# Altium schematic sheet FPGA_SUP.SchDoc
size 420 x 297 mm
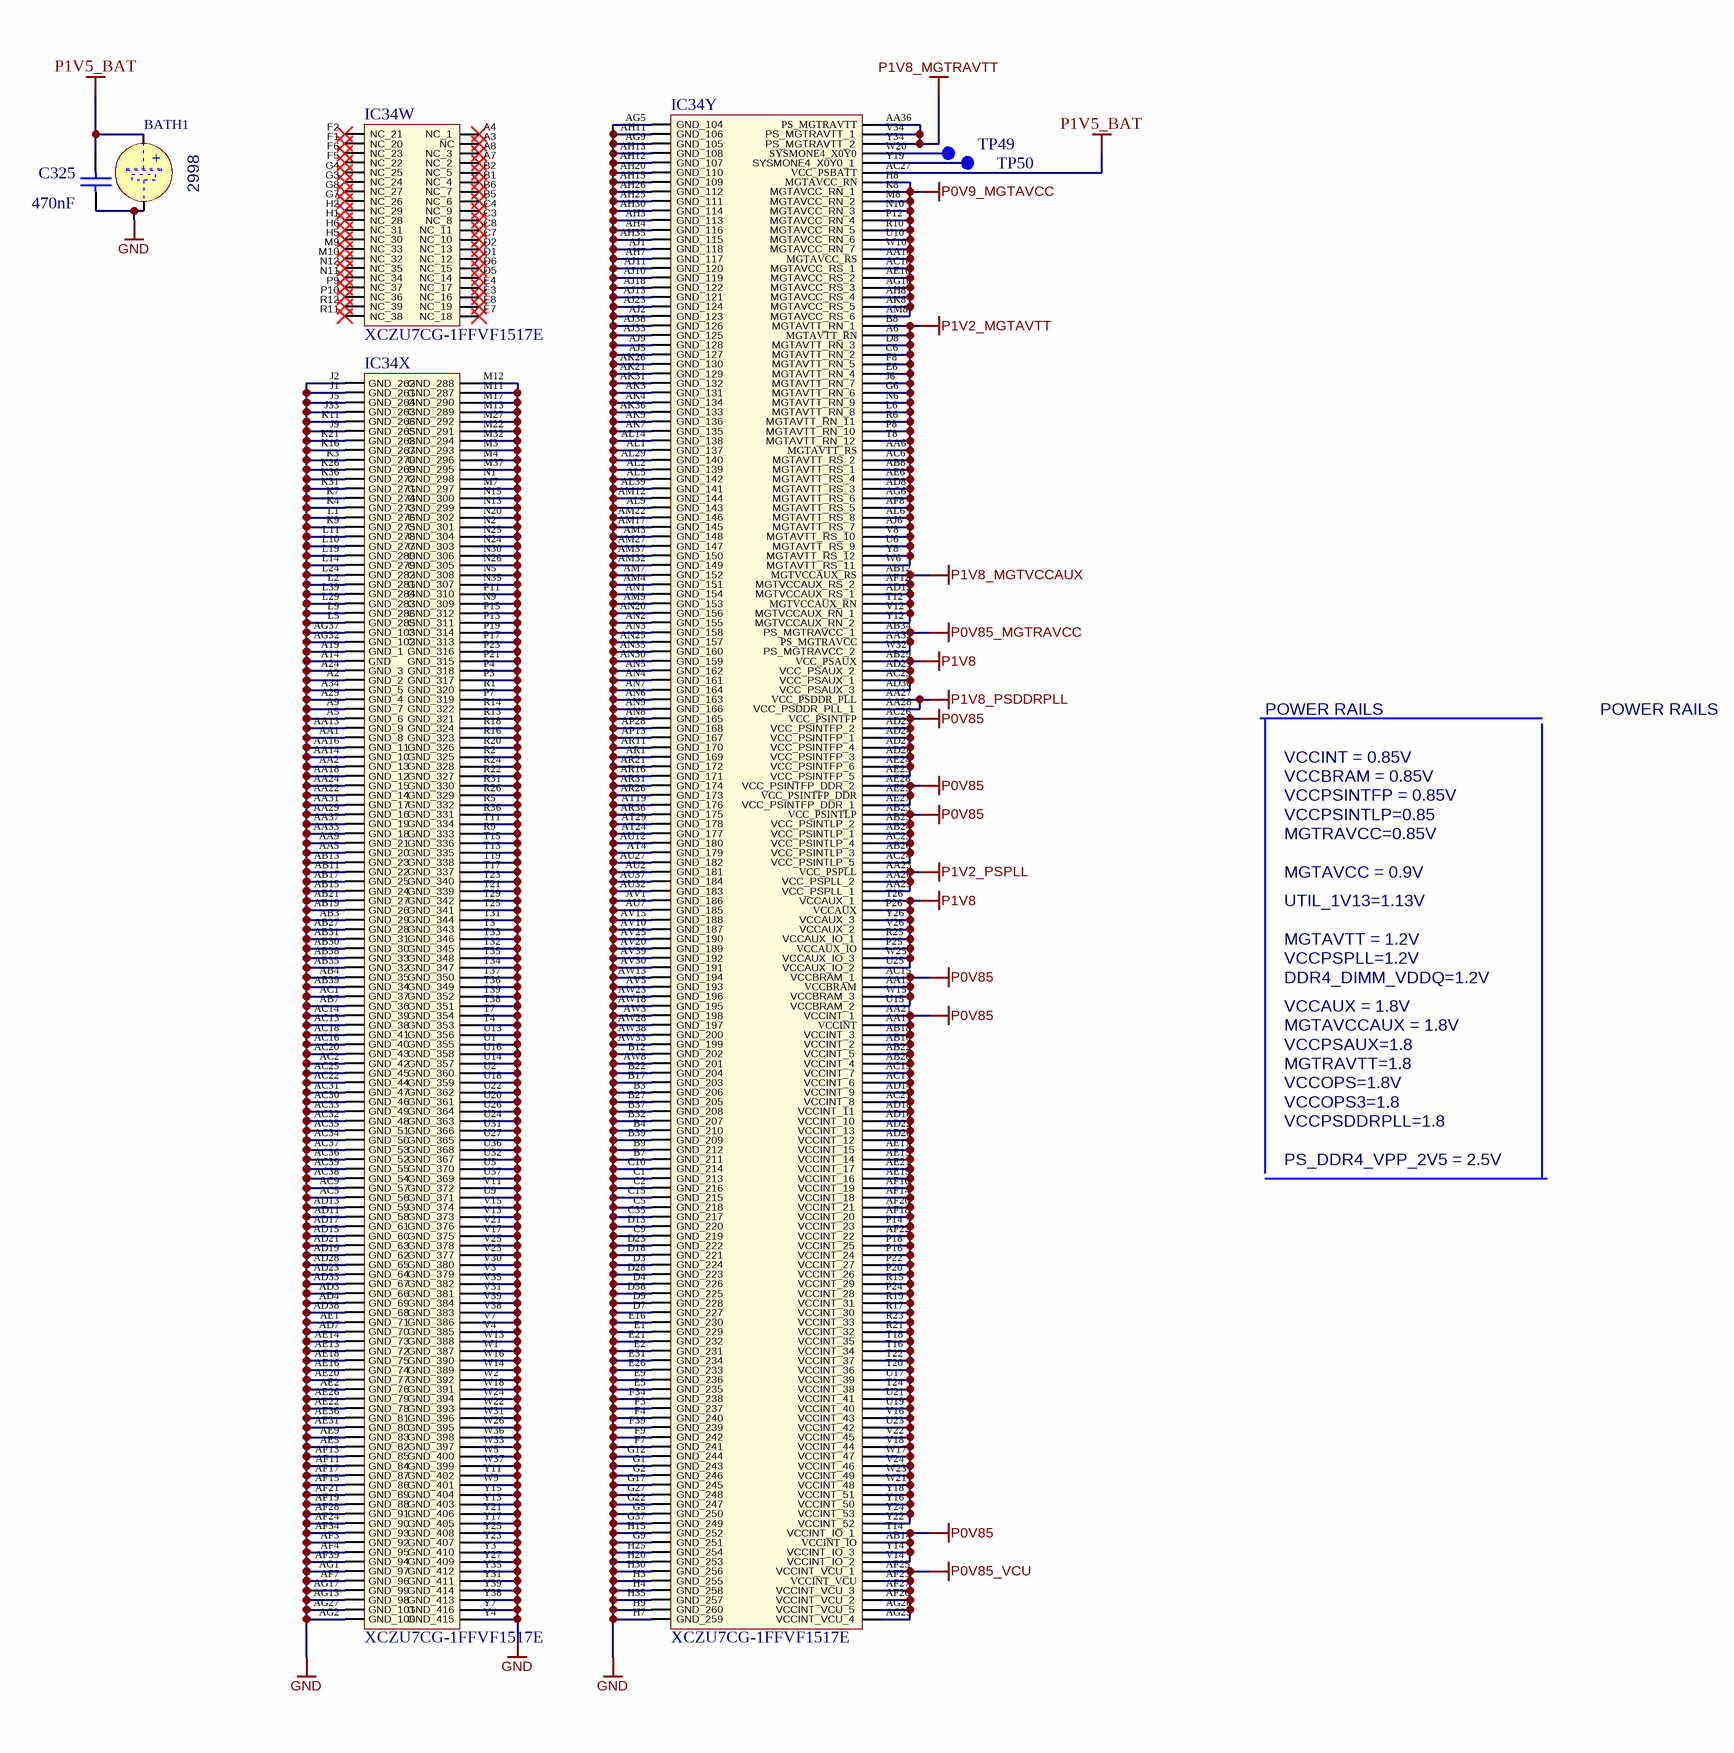
[diagram p0: FPGA_SUP.SchDoc]

## Parts
BATH1  Manufacturer Part Number: 2998  [BATH_KEYSTONE_2998]
C325  470nF  [CAPC0603X33N]
IC34  XCZU7CG-1FFVF1517E  (parts W,X,Y of 26)
TP49  SMD Pad  [C100]  (value not drawn)
TP50  SMD Pad  [C100]  (value not drawn)

## Nets
GND: BATH1.2(MINUS) C325.1 IC34.A2(GND_2) IC34.A5(GND_6) IC34.A9(GND_7) IC34.A14(GND) IC34.A19(GND_1) IC34.A24(GND_3) IC34.A29(GND_4) IC34.A34(GND_5) IC34.AA1(GND_8) IC34.AA2(GND_13) IC34.AA5(GND_20) IC34.AA9(GND_21) IC34.AA13(GND_9) IC34.AA14(GND_10) IC34.AA16(GND_11) IC34.AA18(GND_12) IC34.AA22(GND_14) IC34.AA24(GND_15) IC34.AA29(GND_16) IC34.AA31(GND_17) IC34.AA33(GND_18) IC34.AA37(GND_19) IC34.AB3(GND_29) IC34.AB4(GND_35) IC34.AB7(GND_36) IC34.AB11(GND_22) IC34.AB13(GND_23) IC34.AB15(GND_24) IC34.AB17(GND_25) IC34.AB19(GND_26) IC34.AB21(GND_27) IC34.AB27(GND_28) IC34.AB30(GND_30) IC34.AB31(GND_31) IC34.AB35(GND_32) IC34.AB38(GND_33) IC34.AB39(GND_34) IC34.AC1(GND_37) IC34.AC2(GND_42) IC34.AC5(GND_56) IC34.AC9(GND_57) IC34.AC13(GND_38) IC34.AC14(GND_39) IC34.AC16(GND_40) IC34.AC18(GND_41) IC34.AC20(GND_43) IC34.AC22(GND_44) IC34.AC25(GND_45) IC34.AC30(GND_46) IC34.AC31(GND_47) IC34.AC32(GND_48) IC34.AC33(GND_49) IC34.AC34(GND_50) IC34.AC35(GND_51) IC34.AC36(GND_52) IC34.AC37(GND_53) IC34.AC38(GND_54) IC34.AC39(GND_55) IC34.AD3(GND_66) IC34.AD4(GND_69) IC34.AD7(GND_70) IC34.AD11(GND_58) IC34.AD13(GND_59) IC34.AD15(GND_60) IC34.AD17(GND_61) IC34.AD19(GND_62) IC34.AD21(GND_63) IC34.AD23(GND_64) IC34.AD28(GND_65) IC34.AD33(GND_67) IC34.AD38(GND_68) IC34.AE1(GND_71) IC34.AE2(GND_76) IC34.AE5(GND_82) IC34.AE9(GND_83) IC34.AE13(GND_72) IC34.AE14(GND_73) IC34.AE16(GND_74) IC34.AE18(GND_75) IC34.AE20(GND_77) IC34.AE22(GND_78) IC34.AE26(GND_79) IC34.AE31(GND_80) IC34.AE36(GND_81) IC34.AF3(GND_92) IC34.AF4(GND_95) IC34.AF7(GND_96) IC34.AF11(GND_84) IC34.AF13(GND_85) IC34.AF15(GND_86) IC34.AF17(GND_87) IC34.AF19(GND_88) IC34.AF21(GND_89) IC34.AF24(GND_90) IC34.AF28(GND_91) IC34.AF34(GND_93) IC34.AF39(GND_94) IC34.AG1(GND_97) IC34.AG2(GND_100) IC34.AG5(GND_104) IC34.AG9(GND_105) IC34.AG13(GND_98) IC34.AG17(GND_99) IC34.AG27(GND_101) IC34.AG32(GND_102) IC34.AG37(GND_103) IC34.AH3(GND_113) IC34.AH4(GND_116) IC34.AH7(GND_117) IC34.AH11(GND_106) IC34.AH12(GND_107) IC34.AH13(GND_108) IC34.AH15(GND_109) IC34.AH20(GND_110) IC34.AH25(GND_111) IC34.AH26(GND_112) IC34.AH30(GND_114) IC34.AH35(GND_115) IC34.AJ1(GND_118) IC34.AJ2(GND_123) IC34.AJ5(GND_127) IC34.AJ9(GND_128) IC34.AJ10(GND_119) IC34.AJ11(GND_120) IC34.AJ13(GND_121) IC34.AJ18(GND_122) IC34.AJ23(GND_124) IC34.AJ33(GND_125) IC34.AJ38(GND_126) IC34.AK3(GND_131) IC34.AK4(GND_134) IC34.AK7(GND_135) IC34.AK9(GND_136) IC34.AK21(GND_129) IC34.AK26(GND_130) IC34.AK31(GND_132) IC34.AK36(GND_133) IC34.AL1(GND_137) IC34.AL2(GND_139) IC34.AL5(GND_142) IC34.AL9(GND_143) IC34.AL14(GND_138) IC34.AL29(GND_140) IC34.AL39(GND_141) IC34.AM3(GND_148) IC34.AM4(GND_151) IC34.AM7(GND_152) IC34.AM9(GND_153) IC34.AM12(GND_144) IC34.AM17(GND_145) IC34.AM22(GND_146) IC34.AM27(GND_147) IC34.AM32(GND_149) IC34.AM37(GND_150) IC34.AN1(GND_154) IC34.AN2(GND_155) IC34.AN3(GND_158) IC34.AN4(GND_161) IC34.AN5(GND_162) IC34.AN6(GND_163) IC34.AN7(GND_164) IC34.AN8(GND_165) IC34.AN9(GND_166) IC34.AN20(GND_156) IC34.AN25(GND_157) IC34.AN30(GND_159) IC34.AN35(GND_160) IC34.AP13(GND_167) IC34.AP28(GND_168) IC34.AR1(GND_169) IC34.AR11(GND_170) IC34.AR16(GND_171) IC34.AR21(GND_172) IC34.AR26(GND_173) IC34.AR31(GND_174) IC34.AR36(GND_175) IC34.AT4(GND_179) IC34.AT19(GND_176) IC34.AT24(GND_177) IC34.AT29(GND_178) IC34.AU2(GND_181) IC34.AU7(GND_185) IC34.AU12(GND_180) IC34.AU27(GND_182) IC34.AU32(GND_183) IC34.AU37(GND_184) IC34.AV1(GND_186) IC34.AV5(GND_193) IC34.AV10(GND_187) IC34.AV15(GND_188) IC34.AV20(GND_189) IC34.AV25(GND_190) IC34.AV30(GND_191) IC34.AV39(GND_192) IC34.AW3(GND_198) IC34.AW8(GND_201) IC34.AW13(GND_194) IC34.AW18(GND_195) IC34.AW23(GND_196) IC34.AW28(GND_197) IC34.AW33(GND_199) IC34.AW38(GND_200) IC34.B3(GND_206) IC34.B4(GND_210) IC34.B7(GND_211) IC34.B9(GND_212) IC34.B12(GND_202) IC34.B17(GND_203) IC34.B22(GND_204) IC34.B27(GND_205) IC34.B32(GND_207) IC34.B37(GND_208) IC34.B39(GND_209) IC34.C1(GND_213) IC34.C2(GND_216) IC34.C5(GND_218) IC34.C9(GND_219) IC34.C10(GND_214) IC34.C15(GND_215) IC34.C35(GND_217) IC34.D3(GND_224) IC34.D4(GND_226) IC34.D7(GND_227) IC34.D9(GND_228) IC34.D13(GND_220) IC34.D18(GND_221) IC34.D23(GND_222) IC34.D28(GND_223) IC34.D38(GND_225) IC34.E1(GND_229) IC34.E2(GND_231) IC34.E5(GND_235) IC34.E9(GND_236) IC34.E16(GND_230) IC34.E21(GND_232) IC34.E26(GND_233) IC34.E31(GND_234) IC34.F3(GND_237) IC34.F4(GND_240) IC34.F7(GND_241) IC34.F9(GND_242) IC34.F34(GND_238) IC34.F39(GND_239) IC34.G1(GND_243) IC34.G2(GND_246) IC34.G5(GND_250) IC34.G9(GND_251) IC34.G12(GND_244) IC34.G17(GND_245) IC34.G22(GND_247) IC34.G27(GND_248) IC34.G37(GND_249) IC34.H3(GND_255) IC34.H4(GND_258) IC34.H7(GND_259) IC34.H9(GND_260) IC34.H15(GND_252) IC34.H20(GND_253) IC34.H25(GND_254) IC34.H30(GND_256) IC34.H35(GND_257) IC34.J1(GND_261) IC34.J2(GND_262) IC34.J5(GND_264) IC34.J9(GND_265) IC34.J33(GND_263) IC34.K3(GND_270) IC34.K4(GND_273) IC34.K7(GND_274) IC34.K9(GND_275) IC34.K11(GND_266) IC34.K16(GND_267) IC34.K21(GND_268) IC34.K26(GND_269) IC34.K31(GND_271) IC34.K36(GND_272) IC34.L1(GND_276) IC34.L2(GND_281) IC34.L5(GND_285) IC34.L9(GND_286) IC34.L10(GND_277) IC34.L11(GND_278) IC34.L14(GND_279) IC34.L19(GND_280) IC34.L24(GND_282) IC34.L29(GND_283) IC34.L39(GND_284) IC34.M3(GND_293) IC34.M4(GND_296) IC34.M7(GND_297) IC34.M11(GND_287) IC34.M12(GND_288) IC34.M13(GND_289) IC34.M17(GND_290) IC34.M22(GND_291) IC34.M27(GND_292) IC34.M32(GND_294) IC34.M37(GND_295) IC34.N1(GND_298) IC34.N2(GND_301) IC34.N5(GND_308) IC34.N9(GND_309) IC34.N13(GND_299) IC34.N15(GND_300) IC34.N20(GND_302) IC34.N24(GND_303) IC34.N25(GND_304) IC34.N26(GND_305) IC34.N30(GND_306) IC34.N35(GND_307) IC34.P3(GND_317) IC34.P4(GND_318) IC34.P7(GND_319) IC34.P11(GND_310) IC34.P13(GND_311) IC34.P15(GND_312) IC34.P17(GND_313) IC34.P19(GND_314) IC34.P21(GND_315) IC34.P23(GND_316) IC34.R1(GND_320) IC34.R2(GND_325) IC34.R5(GND_332) IC34.R9(GND_333) IC34.R13(GND_321) IC34.R14(GND_322) IC34.R16(GND_323) IC34.R18(GND_324) IC34.R20(GND_326) IC34.R22(GND_327) IC34.R24(GND_328) IC34.R26(GND_329) IC34.R31(GND_330) IC34.R36(GND_331) IC34.T3(GND_343) IC34.T4(GND_353) IC34.T7(GND_354) IC34.T11(GND_334) IC34.T13(GND_335) IC34.T15(GND_336) IC34.T17(GND_337) IC34.T19(GND_338) IC34.T21(GND_339) IC34.T23(GND_340) IC34.T25(GND_341) IC34.T29(GND_342) IC34.T31(GND_344) IC34.T32(GND_345) IC34.T33(GND_346) IC34.T34(GND_347) IC34.T35(GND_348) IC34.T36(GND_349) IC34.T37(GND_350) IC34.T38(GND_351) IC34.T39(GND_352) IC34.U1(GND_355) IC34.U2(GND_360) IC34.U5(GND_370) IC34.U9(GND_371) IC34.U13(GND_356) IC34.U14(GND_357) IC34.U16(GND_358) IC34.U18(GND_359) IC34.U20(GND_361) IC34.U22(GND_362) IC34.U24(GND_363) IC34.U26(GND_364) IC34.U27(GND_365) IC34.U31(GND_366) IC34.U32(GND_367) IC34.U36(GND_368) IC34.U37(GND_369) IC34.V3(GND_379) IC34.V4(GND_385) IC34.V7(GND_386) IC34.V11(GND_372) IC34.V13(GND_373) IC34.V15(GND_374) IC34.V17(GND_375) IC34.V21(GND_376) IC34.V23(GND_377) IC34.V25(GND_378) IC34.V30(GND_380) IC34.V31(GND_381) IC34.V35(GND_382) IC34.V38(GND_383) IC34.V39(GND_384) IC34.W1(GND_387) IC34.W2(GND_392) IC34.W5(GND_400) IC34.W9(GND_401) IC34.W13(GND_388) IC34.W14(GND_389) IC34.W16(GND_390) IC34.W18(GND_391) IC34.W22(GND_393) IC34.W24(GND_394) IC34.W26(GND_395) IC34.W31(GND_396) IC34.W33(GND_397) IC34.W36(GND_398) IC34.W37(GND_399) IC34.Y3(GND_410) IC34.Y4(GND_415) IC34.Y7(GND_416) IC34.Y11(GND_402) IC34.Y13(GND_403) IC34.Y15(GND_404) IC34.Y17(GND_405) IC34.Y21(GND_406) IC34.Y23(GND_407) IC34.Y25(GND_408) IC34.Y27(GND_409) IC34.Y31(GND_411) IC34.Y35(GND_412) IC34.Y38(GND_413) IC34.Y39(GND_414)
P0V9_MGTAVCC: IC34.AA10(MGTAVCC_RS) IC34.AC10(MGTAVCC_RS_1) IC34.AE10(MGTAVCC_RS_2) IC34.AG10(MGTAVCC_RS_3) IC34.AH8(MGTAVCC_RS_4) IC34.AK8(MGTAVCC_RS_5) IC34.AM8(MGTAVCC_RS_6) IC34.H8(MGTAVCC_RN) IC34.K8(MGTAVCC_RN_1) IC34.M8(MGTAVCC_RN_2) IC34.N10(MGTAVCC_RN_3) IC34.P12(MGTAVCC_RN_4) IC34.R10(MGTAVCC_RN_5) IC34.U10(MGTAVCC_RN_6) IC34.W10(MGTAVCC_RN_7)
P0V85: IC34.AA15(VCCBRAM) IC34.AA17(VCCINT) IC34.AA21(VCCINT_1) IC34.AB14(VCCINT_IO) IC34.AB16(VCCINT_2) IC34.AB18(VCCINT_3) IC34.AB20(VCCINT_4) IC34.AB22(VCCINT_5) IC34.AB23(VCC_PSINTLP) IC34.AB24(VCC_PSINTLP_1) IC34.AB25(VCC_PSINTLP_2) IC34.AB26(VCC_PSINTLP_3) IC34.AC15(VCCBRAM_1) IC34.AC17(VCCINT_6) IC34.AC19(VCCINT_7) IC34.AC21(VCCINT_8) IC34.AC23(VCC_PSINTLP_4) IC34.AC24(VCC_PSINTLP_5) IC34.AC26(VCC_PSINTFP) IC34.AD14(VCCINT_9) IC34.AD16(VCCINT_10) IC34.AD18(VCCINT_11) IC34.AD20(VCCINT_12) IC34.AD22(VCCINT_13) IC34.AD24(VCC_PSINTFP_1) IC34.AD25(VCC_PSINTFP_2) IC34.AD26(VCC_PSINTFP_3) IC34.AD27(VCC_PSINTFP_4) IC34.AE15(VCCINT_14) IC34.AE17(VCCINT_15) IC34.AE19(VCCINT_16) IC34.AE21(VCCINT_17) IC34.AE23(VCC_PSINTFP_5) IC34.AE24(VCC_PSINTFP_6) IC34.AE25(VCC_PSINTFP_DDR) IC34.AE27(VCC_PSINTFP_DDR_1) IC34.AE28(VCC_PSINTFP_DDR_2) IC34.AF14(VCCINT_18) IC34.AF16(VCCINT_19) IC34.AF18(VCCINT_20) IC34.AF20(VCCINT_21) IC34.AF22(VCCINT_22) IC34.P14(VCCINT_23) IC34.P16(VCCINT_24) IC34.P18(VCCINT_25) IC34.P20(VCCINT_26) IC34.P22(VCCINT_27) IC34.P24(VCCINT_28) IC34.R15(VCCINT_29) IC34.R17(VCCINT_30) IC34.R19(VCCINT_31) IC34.R21(VCCINT_32) IC34.R23(VCCINT_33) IC34.T14(VCCINT_IO_1) IC34.T16(VCCINT_34) IC34.T18(VCCINT_35) IC34.T20(VCCINT_36) IC34.T22(VCCINT_37) IC34.T24(VCCINT_38) IC34.U15(VCCBRAM_2) IC34.U17(VCCINT_39) IC34.U19(VCCINT_40) IC34.U21(VCCINT_41) IC34.U23(VCCINT_42) IC34.V14(VCCINT_IO_2) IC34.V16(VCCINT_43) IC34.V18(VCCINT_44) IC34.V22(VCCINT_45) IC34.V24(VCCINT_46) IC34.W15(VCCBRAM_3) IC34.W17(VCCINT_47) IC34.W21(VCCINT_48) IC34.W23(VCCINT_49) IC34.Y14(VCCINT_IO_3) IC34.Y16(VCCINT_50) IC34.Y18(VCCINT_51) IC34.Y22(VCCINT_52) IC34.Y24(VCCINT_53)
P0V85_MGTRAVCC: IC34.AA32(PS_MGTRAVCC) IC34.AB34(PS_MGTRAVCC_1) IC34.W32(PS_MGTRAVCC_2)
P0V85_VCU: IC34.AF23(VCCINT_VCU) IC34.AF25(VCCINT_VCU_1) IC34.AF26(VCCINT_VCU_2) IC34.AF27(VCCINT_VCU_3) IC34.AG25(VCCINT_VCU_4) IC34.AG26(VCCINT_VCU_5)
P1V2_MGTAVTT: IC34.A6(MGTAVTT_RN) IC34.AA6(MGTAVTT_RS) IC34.AB8(MGTAVTT_RS_1) IC34.AC6(MGTAVTT_RS_2) IC34.AD8(MGTAVTT_RS_3) IC34.AE6(MGTAVTT_RS_4) IC34.AF8(MGTAVTT_RS_5) IC34.AG6(MGTAVTT_RS_6) IC34.AJ6(MGTAVTT_RS_7) IC34.AL6(MGTAVTT_RS_8) IC34.B8(MGTAVTT_RN_1) IC34.C6(MGTAVTT_RN_2) IC34.D8(MGTAVTT_RN_3) IC34.E6(MGTAVTT_RN_4) IC34.F8(MGTAVTT_RN_5) IC34.G6(MGTAVTT_RN_6) IC34.J6(MGTAVTT_RN_7) IC34.L6(MGTAVTT_RN_8) IC34.N6(MGTAVTT_RN_9) IC34.P8(MGTAVTT_RN_10) IC34.R6(MGTAVTT_RN_11) IC34.T8(MGTAVTT_RN_12) IC34.U6(MGTAVTT_RS_9) IC34.V8(MGTAVTT_RS_10) IC34.W6(MGTAVTT_RS_11) IC34.Y8(MGTAVTT_RS_12)
P1V2_PSPLL: IC34.AA23(VCC_PSPLL) IC34.AA25(VCC_PSPLL_1) IC34.AA26(VCC_PSPLL_2)
P1V5_BAT: BATH1.1(PLUS) C325.2 IC34.AC27(VCC_PSBATT)
P1V8: IC34.AB29(VCC_PSAUX) IC34.AC29(VCC_PSAUX_1) IC34.AD29(VCC_PSAUX_2) IC34.AD30(VCC_PSAUX_3) IC34.P25(VCCAUX_IO) IC34.P26(VCCAUX) IC34.R25(VCCAUX_IO_1) IC34.T26(VCCAUX_1) IC34.U25(VCCAUX_IO_2) IC34.V26(VCCAUX_2) IC34.W25(VCCAUX_IO_3) IC34.Y26(VCCAUX_3)
P1V8_MGTRAVTT: IC34.AA36(PS_MGTRAVTT) IC34.V34(PS_MGTRAVTT_1) IC34.Y34(PS_MGTRAVTT_2)
P1V8_MGTVCCAUX: IC34.AB12(MGTVCCAUX_RS) IC34.AD12(MGTVCCAUX_RS_1) IC34.AF12(MGTVCCAUX_RS_2) IC34.T12(MGTVCCAUX_RN) IC34.V12(MGTVCCAUX_RN_1) IC34.Y12(MGTVCCAUX_RN_2)
P1V8_PSDDRPLL: IC34.AA27(VCC_PSDDR_PLL) IC34.AA28(VCC_PSDDR_PLL_1)
NetIC34_W20: IC34.W20(SYSMONE4_X0Y0) TP49.1
NetIC34_Y19: IC34.Y19(SYSMONE4_X0Y0_1) TP50.1

Not connected (* = marked no-connect by the designer): IC34 A3(NC)* A4(NC_1)* A7(NC_2)* A8(NC_3)* B1(NC_4)* B2(NC_5)* B5(NC_6)* B6(NC_7)* C3(NC_8)* C4(NC_9)* C7(NC_10)* C8(NC_11)* D1(NC_12)* D2(NC_13)* D5(NC_14)* D6(NC_15)* E3(NC_16)* E4(NC_17)* E7(NC_18)* E8(NC_19)* F1(NC_20)* F2(NC_21)* F5(NC_22)* F6(NC_23)* G3(NC_24)* G4(NC_25)* G7(NC_26)* G8(NC_27)* H1(NC_28)* H2(NC_29)* H5(NC_30)* H6(NC_31)* M9(NC_33)* M10(NC_32)* N11(NC_34)* N12(NC_35)* P9(NC_37)* P10(NC_36)* R11(NC_38)* R12(NC_39)*

## Notes on the sheet
- POWER RAILS
- VCCINT = 0.85V
- VCCBRAM = 0.85V
- VCCPSINTFP = 0.85V
- VCCPSINTLP=0.85
- MGTAVCC = 0.9V
- MGTRAVCC=0.85V
- UTIL_1V13=1.13V
- VCCAUX = 1.8V
- MGTAVTT = 1.2V
- VCCPSPLL=1.2V
- DDR4_DIMM_VDDQ=1.2V
- MGTAVCCAUX = 1.8V
- VCCPSAUX=1.8
- MGTRAVTT=1.8
- VCCOPS=1.8V
- PS_DDR4_VPP_2V5 = 2.5V
- VCCOPS3=1.8
- VCCPSDDRPLL=1.8
- Project/Equipment
- Document
- Designer
- Drawn by
- Check.by
- Copyright WUT ISE 2020.
  This documentation describes Open Hardware and is licensed under the CERN OHL v.1.2. You may redistribute and modify this documentation under the terms of the CERN OHL v.1.2. (http://ohwr.org/CERNOHL). This documentation is distributed WITHOUT ANY EXPRESS OR IMPLIED WARRANTY, INCLUDING OF MERCHANTABILITY, SATISFACTORY QUALITY AND FITNESS FOR A PARTICULAR PURPOSE. Please see the CERN OHL v.1.2 for applicable conditions.
- Contact
- File
- Last Mod.
- Print Date
- Sheet
- Size
- A3
- of
- Rev
- (in symbol BATH_KEYSTONE_2998) +

## Library data of the parts
BATH1 = BATH_KEYSTONE_2998: Battery Holder whit 2 Pin; Part Description: SMD Battery Holder for MC621, V364, SC621, DR13H, DR77, V13AT, 377 Button Cells; PressFit: No; Manufacturer: KEYSTONE; PackageDescription: SMD Battery Holder for MC621, V364, SC621, DR13H, DR77, V13AT, 377 Button Cells; Part Number: BATH_KEYSTONE_2998; Component Kind: Standard; Component Type: Standard; Pin Count: 3; Family: Battery; Mounted: Yes; Socket: No; SMD: Yes; Sense: No; ComponentHeight: 3.048mm; HelpURL: \\cern.ch\dfs\Applications\Altium\Datasheets\BATH_KEYSTONE_2998.pdf; Author: CERN DEM JLC; CreateDate: 03.07.2014; LatestRevisionDate: 07.06.2017
C325 = CC0201_470NF_4V_20%_X5R: Non-polarised capacitor; Manufacturer: GENERIC; Manufacturer1 Part Number: AMK063BJ474MP-F; Part Description: SMD Multilayer Chip Ceramic Capacitor; TC: X5R; Tolerance: ±20%; Voltage: 4V; Author: CERN DEM JLC; Case: 0201; Component Kind: Standard; Component Type: Standard; CreateDate: 27/05/2010; HelpURL: \\cern.ch\dfs\Applications\Altium\Datasheets\CC0201_X5R_TAIYO-YUDEN_STANDARD-CLASS2.pdf; LatestRevisionDate: 27/05/2010; Manufacturer Part Number: CC0201_470NF_4V_20%_X5R; Manufacturer1 ComponentHeight: 0.33mm; Manufacturer1 Example: TAIYO YUDEN; Mounted: Yes; Part Number: CC0201_470NF_4V_20%_X5R; Pin Count: 2; SMD: Yes; Socket: No; Status: Not Recommended; Value: 470nF; Sense: No
TP49 TP50 = SMD_PAD_D1MM: Through Hole Pad; Part Description: 1mm Diameter SMD Pad; Mounted: No; PackageDescription: 1mm Diameter SMD Pad; Part Number: SMD_PAD_D1MM; Component Kind: Standard (No BOM); Component Type: Standard (No BOM); Pin Count: 1; Family: SMD Pad; Socket: No; SMD: No; Sense: No; Status: None; ComponentHeight: 0mm; HelpURL: Undefined; Author: CERN DEM JLC; CreateDate: 10/10/2017; LatestRevisionDate: 10/10/2017